# Altium schematic sheet GridSeed.SchDoc (part 1 of 2) (continued)
## Parts (continued)
C74  DB_VALUE: 470nF  [SMD_0603_CAPC1608X95N]
C75  DB_VALUE: 470nF  [SMD_0603_CAPC1608X95N]
C76  DB_VALUE: 470nF  [SMD_0603_CAPC1608X95N]
C77  DB_VALUE: 470nF  [SMD_0603_CAPC1608X95N]
C78  DB_VALUE: 470nF  [SMD_0603_CAPC1608X95N]
C79  DB_VALUE: 470nF  [SMD_0603_CAPC1608X95N]
C80  DB_VALUE: 470nF  [SMD_0603_CAPC1608X95N]
C81  DB_VALUE: 470nF  [SMD_0603_CAPC1608X95N]
C82  DB_VALUE: 470nF  [SMD_0603_CAPC1608X95N]
C83  DB_VALUE: 470nF  [SMD_0603_CAPC1608X95N]
C84  DB_VALUE: 470nF  [SMD_0603_CAPC1608X95N]
C85  DB_VALUE: 470nF  [SMD_0603_CAPC1608X95N]
C86  DB_VALUE: 2.2uF  DB_TOLERANCE: 5%  DB_VOLTAGE: 10V  [SMD_0805_CAPC2012X145N]
C87  DB_VALUE: 100pF  DB_TOLERANCE: 5%  DB_VOLTAGE: 50V  [SMD_0805_CAPC2012X145N]
C88  DB_VALUE: 47pF  DB_TOLERANCE: 5%  DB_VOLTAGE: 50V  [SMD_0805_CAPC2012X145N]
C89  DB_VALUE: 22pF  DB_TOLERANCE: 5%  DB_VOLTAGE: 50V  [SMD_0805_CAPC2012X145N]
C90  DB_VALUE: 2.2uF  DB_TOLERANCE: 5%  DB_VOLTAGE: 10V  [SMD_0805_CAPC2012X145N]
C91  DB_VALUE: 100pF  DB_TOLERANCE: 5%  DB_VOLTAGE: 50V  [SMD_0805_CAPC2012X145N]
C92  DB_VALUE: 47pF  DB_TOLERANCE: 5%  DB_VOLTAGE: 50V  [SMD_0805_CAPC2012X145N]
C93  DB_VALUE: 22pF  DB_TOLERANCE: 5%  DB_VOLTAGE: 50V  [SMD_0805_CAPC2012X145N]
C94  DB_VALUE: 2.2uF  DB_TOLERANCE: 5%  DB_VOLTAGE: 10V  [SMD_0805_CAPC2012X145N]
C95  DB_VALUE: 100pF  DB_TOLERANCE: 5%  DB_VOLTAGE: 50V  [SMD_0805_CAPC2012X145N]
C96  DB_VALUE: 47pF  DB_TOLERANCE: 5%  DB_VOLTAGE: 50V  [SMD_0805_CAPC2012X145N]
C97  DB_VALUE: 22pF  DB_TOLERANCE: 5%  DB_VOLTAGE: 50V  [SMD_0805_CAPC2012X145N]
C98  DB_VALUE: 2.2uF  DB_TOLERANCE: 5%  DB_VOLTAGE: 10V  [SMD_0805_CAPC2012X145N]
C99  DB_VALUE: 100pF  DB_TOLERANCE: 5%  DB_VOLTAGE: 50V  [SMD_0805_CAPC2012X145N]
C100  DB_VALUE: 47pF  DB_TOLERANCE: 5%  DB_VOLTAGE: 50V  [SMD_0805_CAPC2012X145N]
C101  DB_VALUE: 22pF  DB_TOLERANCE: 5%  DB_VOLTAGE: 50V  [SMD_0805_CAPC2012X145N]
C102  DB_VALUE: 2.2uF  DB_TOLERANCE: 5%  DB_VOLTAGE: 10V  [SMD_0805_CAPC2012X145N]
C103  DB_VALUE: 100pF  DB_TOLERANCE: 5%  DB_VOLTAGE: 50V  [SMD_0805_CAPC2012X145N]
C104  DB_VALUE: 47pF  DB_TOLERANCE: 5%  DB_VOLTAGE: 50V  [SMD_0805_CAPC2012X145N]
C105  DB_VALUE: 22pF  DB_TOLERANCE: 5%  DB_VOLTAGE: 50V  [SMD_0805_CAPC2012X145N]
C106  DB_VALUE: 2.2uF  DB_TOLERANCE: 5%  DB_VOLTAGE: 10V  [SMD_0805_CAPC2012X145N]
C107  DB_VALUE: 100pF  DB_TOLERANCE: 5%  DB_VOLTAGE: 50V  [SMD_0805_CAPC2012X145N]
C108  DB_VALUE: 47pF  DB_TOLERANCE: 5%  DB_VOLTAGE: 50V  [SMD_0805_CAPC2012X145N]
C109  DB_VALUE: 22pF  DB_TOLERANCE: 5%  DB_VOLTAGE: 50V  [SMD_0805_CAPC2012X145N]
C110  DB_VALUE: 2.2uF  DB_TOLERANCE: 5%  DB_VOLTAGE: 10V  [SMD_0805_CAPC2012X145N]
C111  DB_VALUE: 100pF  DB_TOLERANCE: 5%  DB_VOLTAGE: 50V  [SMD_0805_CAPC2012X145N]
C112  DB_VALUE: 47pF  DB_TOLERANCE: 5%  DB_VOLTAGE: 50V  [SMD_0805_CAPC2012X145N]
C113  DB_VALUE: 22pF  DB_TOLERANCE: 5%  DB_VOLTAGE: 50V  [SMD_0805_CAPC2012X145N]
C114  DB_VALUE: 2.2uF  DB_TOLERANCE: 5%  DB_VOLTAGE: 10V  [SMD_0805_CAPC2012X145N]
C115  DB_VALUE: 100pF  DB_TOLERANCE: 5%  DB_VOLTAGE: 50V  [SMD_0805_CAPC2012X145N]
C116  DB_VALUE: 47pF  DB_TOLERANCE: 5%  DB_VOLTAGE: 50V  [SMD_0805_CAPC2012X145N]
C117  DB_VALUE: 22pF  DB_TOLERANCE: 5%  DB_VOLTAGE: 50V  [SMD_0805_CAPC2012X145N]
C118  DB_VALUE: 470nF  [SMD_0603_CAPC1608X95N]
C119  DB_VALUE: 470nF  [SMD_0603_CAPC1608X95N]
C120  DB_VALUE: 470nF  [SMD_0603_CAPC1608X95N]
C121  DB_VALUE: 470nF  [SMD_0603_CAPC1608X95N]
C122  DB_VALUE: 470nF  [SMD_0603_CAPC1608X95N]
C123  DB_VALUE: 470nF  [SMD_0603_CAPC1608X95N]
C124  DB_VALUE: 470nF  [SMD_0603_CAPC1608X95N]
C125  DB_VALUE: 470nF  [SMD_0603_CAPC1608X95N]
C126  DB_VALUE: 470nF  [SMD_0603_CAPC1608X95N]
C127  DB_VALUE: 470nF  [SMD_0603_CAPC1608X95N]
C128  DB_VALUE: 470nF  [SMD_0603_CAPC1608X95N]
C129  DB_VALUE: 470nF  [SMD_0603_CAPC1608X95N]
C130  DB_VALUE: 470nF  [SMD_0603_CAPC1608X95N]
C131  DB_VALUE: 470nF  [SMD_0603_CAPC1608X95N]
C132  DB_VALUE: 470nF  [SMD_0603_CAPC1608X95N]
C133  DB_VALUE: 470nF  [SMD_0603_CAPC1608X95N]
C134  DB_VALUE: 470nF  [SMD_0603_CAPC1608X95N]
C135  DB_VALUE: 470nF  [SMD_0603_CAPC1608X95N]
C136  DB_VALUE: 470nF  [SMD_0603_CAPC1608X95N]
C137  DB_VALUE: 470nF  [SMD_0603_CAPC1608X95N]
C138  10uF/16V  DB_VALUE: 10uF  DB_TOLERANCE: 10%  DB_VOLTAGE: 16V  [SMD_0805_CAPC2012X145N]
C139  1nF  [SMD_0603_CAPC1608X95N]
C140  DB_VALUE: 470nF  [SMD_0603_CAPC1608X95N]
C141  DB_VALUE: 470nF  [SMD_0603_CAPC1608X95N]
C142  DB_VALUE: 470nF  [SMD_0603_CAPC1608X95N]
C143  DB_VALUE: 470nF  [SMD_0603_CAPC1608X95N]
C144  DB_VALUE: 470nF  [SMD_0603_CAPC1608X95N]
C145  DB_VALUE: 470nF  [SMD_0603_CAPC1608X95N]
C146  DB_VALUE: 470nF  [SMD_0603_CAPC1608X95N]
C147  DB_VALUE: 470nF  [SMD_0603_CAPC1608X95N]
C148  DB_VALUE: 470nF  [SMD_0603_CAPC1608X95N]
C149  DB_VALUE: 470nF  [SMD_0603_CAPC1608X95N]
C150  DB_VALUE: 470nF  [SMD_0603_CAPC1608X95N]
C151  DB_VALUE: 470nF  [SMD_0603_CAPC1608X95N]
C152  1nF  DB_TOLERANCE: 5%  DB_VOLTAGE: 25V  [SMD_0603_CAPC1608X95N]
C153  DB_VALUE: 470nF  [SMD_0603_CAPC1608X95N]
C154  DB_VALUE: 470nF  [SMD_0603_CAPC1608X95N]
C155  DB_VALUE: 470nF  [SMD_0603_CAPC1608X95N]
C156  DB_VALUE: 470nF  [SMD_0603_CAPC1608X95N]
C157  DB_VALUE: 470nF  [SMD_0603_CAPC1608X95N]
C158  DB_VALUE: 470nF  [SMD_0603_CAPC1608X95N]
C159  DB_VALUE: 470nF  [SMD_0603_CAPC1608X95N]
C160  DB_VALUE: 470nF  [SMD_0603_CAPC1608X95N]
C161  DB_VALUE: 470nF  [SMD_0603_CAPC1608X95N]
C162  DB_VALUE: 470nF  [SMD_0603_CAPC1608X95N]
C163  DB_VALUE: 470nF  [SMD_0603_CAPC1608X95N]
C164  DB_VALUE: 470nF  [SMD_0603_CAPC1608X95N]
C165  100nF  DB_TOLERANCE: 5%  DB_VOLTAGE: 50V  [SMD_0603_CAPC1608X95N]
C166  1nF  DB_TOLERANCE: 5%  DB_VOLTAGE: 25V  [SMD_0603_CAPC1608X95N]
C167  1nF  DB_TOLERANCE: 5%  DB_VOLTAGE: 25V  [SMD_0603_CAPC1608X95N]
C168  100nF  DB_TOLERANCE: 5%  DB_VOLTAGE: 50V  [SMD_0603_CAPC1608X95N]
C169  100nF  DB_TOLERANCE: 5%  DB_VOLTAGE: 50V  [SMD_0603_CAPC1608X95N]
C170  100nF  DB_TOLERANCE: 5%  DB_VOLTAGE: 50V  [SMD_0603_CAPC1608X95N]
C171  100nF  DB_TOLERANCE: 5%  DB_VOLTAGE: 50V  [SMD_0603_CAPC1608X95N]
C172  100nF  DB_TOLERANCE: 5%  DB_VOLTAGE: 50V  [SMD_0603_CAPC1608X95N]
C173  18pF  DB_TOLERANCE: 5%  DB_VOLTAGE: 50V  [SMD_0603_CAPC1608X95N]
C174  18pF  DB_TOLERANCE: 5%  DB_VOLTAGE: 50V  [SMD_0603_CAPC1608X95N]
C175  DB_VALUE: 470nF  [SMD_0603_CAPC1608X95N]
C176  DB_VALUE: 470nF  [SMD_0603_CAPC1608X95N]
C177  DB_VALUE: 470nF  [SMD_0603_CAPC1608X95N]
C178  DB_VALUE: 470nF  [SMD_0603_CAPC1608X95N]
C179  DB_VALUE: 470nF  [SMD_0603_CAPC1608X95N]
C180  DB_VALUE: 470nF  [SMD_0603_CAPC1608X95N]
C181  DB_VALUE: 470nF  [SMD_0603_CAPC1608X95N]
C182  DB_VALUE: 470nF  [SMD_0603_CAPC1608X95N]
C183  DB_VALUE: 470nF  [SMD_0603_CAPC1608X95N]
C184  DB_VALUE: 470nF  [SMD_0603_CAPC1608X95N]
C185  DB_VALUE: 470nF  [SMD_0603_CAPC1608X95N]
C186  DB_VALUE: 470nF  [SMD_0603_CAPC1608X95N]
C187  DB_VALUE: 470nF  [SMD_0603_CAPC1608X95N]
C188  DB_VALUE: 470nF  [SMD_0603_CAPC1608X95N]
C189  DB_VALUE: 470nF  [SMD_0603_CAPC1608X95N]
C190  DB_VALUE: 470nF  [SMD_0603_CAPC1608X95N]
C191  10uF/16V  DB_VALUE: 10uF  DB_TOLERANCE: 10%  DB_VOLTAGE: 16V  [SMD_0805_CAPC2012X145N]
C192  10uF/16V  DB_VALUE: 10uF  DB_TOLERANCE: 10%  DB_VOLTAGE: 16V  [SMD_0805_CAPC2012X145N]
C193  DB_VALUE: 22uF  DB_TOLERANCE: 10%  DB_VOLTAGE: 6.3V  [SMD_1210_CAPC3225X270N]
C194  22uF/6.3V  DB_VALUE: 22uF  DB_TOLERANCE: 20%  DB_VOLTAGE: 6.3V  [SMD_0805_CAPC2012X145N]
C195  DB_VALUE: 2.2uF  DB_TOLERANCE: 5%  DB_VOLTAGE: 10V  [SMD_0805_CAPC2012X145N]
C196  DB_VALUE: 100pF  DB_TOLERANCE: 5%  DB_VOLTAGE: 50V  [SMD_0805_CAPC2012X145N]
C197  47pF  DB_TOLERANCE: 5%  DB_VOLTAGE: 50V  [SMD_0805_CAPC2012X145N]
C198  DB_VALUE: 22pF  DB_TOLERANCE: 5%  DB_VOLTAGE: 50V  [SMD_0805_CAPC2012X145N]
C199  DB_VALUE: 2.2uF  DB_TOLERANCE: 5%  DB_VOLTAGE: 10V  [SMD_0805_CAPC2012X145N]
C200  DB_VALUE: 100pF  DB_TOLERANCE: 5%  DB_VOLTAGE: 50V  [SMD_0805_CAPC2012X145N]
C201  DB_VALUE: 47pF  DB_TOLERANCE: 5%  DB_VOLTAGE: 50V  [SMD_0805_CAPC2012X145N]
C202  DB_VALUE: 22pF  DB_TOLERANCE: 5%  DB_VOLTAGE: 50V  [SMD_0805_CAPC2012X145N]
C203  DB_VALUE: 2.2uF  DB_TOLERANCE: 5%  DB_VOLTAGE: 10V  [SMD_0805_CAPC2012X145N]
C204  DB_VALUE: 100pF  DB_TOLERANCE: 5%  DB_VOLTAGE: 50V  [SMD_0805_CAPC2012X145N]
C205  DB_VALUE: 47pF  DB_TOLERANCE: 5%  DB_VOLTAGE: 50V  [SMD_0805_CAPC2012X145N]
C206  DB_VALUE: 22pF  DB_TOLERANCE: 5%  DB_VOLTAGE: 50V  [SMD_0805_CAPC2012X145N]
C207  DB_VALUE: 2.2uF  DB_TOLERANCE: 5%  DB_VOLTAGE: 10V  [SMD_0805_CAPC2012X145N]
C208  DB_VALUE: 100pF  DB_TOLERANCE: 5%  DB_VOLTAGE: 50V  [SMD_0805_CAPC2012X145N]
C209  DB_VALUE: 47pF  DB_TOLERANCE: 5%  DB_VOLTAGE: 50V  [SMD_0805_CAPC2012X145N]
C210  DB_VALUE: 22pF  DB_TOLERANCE: 5%  DB_VOLTAGE: 50V  [SMD_0805_CAPC2012X145N]
C211  DB_VALUE: 2.2uF  DB_TOLERANCE: 5%  DB_VOLTAGE: 10V  [SMD_0805_CAPC2012X145N]
C212  DB_VALUE: 100pF  DB_TOLERANCE: 5%  DB_VOLTAGE: 50V  [SMD_0805_CAPC2012X145N]
C213  DB_VALUE: 47pF  DB_TOLERANCE: 5%  DB_VOLTAGE: 50V  [SMD_0805_CAPC2012X145N]
C214  DB_VALUE: 22pF  DB_TOLERANCE: 5%  DB_VOLTAGE: 50V  [SMD_0805_CAPC2012X145N]
C215  DB_VALUE: 2.2uF  DB_TOLERANCE: 5%  DB_VOLTAGE: 10V  [SMD_0805_CAPC2012X145N]
C216  DB_VALUE: 100pF  DB_TOLERANCE: 5%  DB_VOLTAGE: 50V  [SMD_0805_CAPC2012X145N]
C217  DB_VALUE: 47pF  DB_TOLERANCE: 5%  DB_VOLTAGE: 50V  [SMD_0805_CAPC2012X145N]
C218  DB_VALUE: 22pF  DB_TOLERANCE: 5%  DB_VOLTAGE: 50V  [SMD_0805_CAPC2012X145N]
C219  DB_VALUE: 2.2uF  DB_TOLERANCE: 5%  DB_VOLTAGE: 10V  [SMD_0805_CAPC2012X145N]
C220  DB_VALUE: 100pF  DB_TOLERANCE: 5%  DB_VOLTAGE: 50V  [SMD_0805_CAPC2012X145N]
C221  DB_VALUE: 47pF  DB_TOLERANCE: 5%  DB_VOLTAGE: 50V  [SMD_0805_CAPC2012X145N]
C222  DB_VALUE: 22pF  DB_TOLERANCE: 5%  DB_VOLTAGE: 50V  [SMD_0805_CAPC2012X145N]
C223  DB_VALUE: 2.2uF  DB_TOLERANCE: 5%  DB_VOLTAGE: 10V  [SMD_0805_CAPC2012X145N]
C224  DB_VALUE: 100pF  DB_TOLERANCE: 5%  DB_VOLTAGE: 50V  [SMD_0805_CAPC2012X145N]
C225  DB_VALUE: 47pF  DB_TOLERANCE: 5%  DB_VOLTAGE: 50V  [SMD_0805_CAPC2012X145N]
C226  DB_VALUE: 22pF  DB_TOLERANCE: 5%  DB_VOLTAGE: 50V  [SMD_0805_CAPC2012X145N]
C227  DB_VALUE: 470nF  [SMD_0603_CAPC1608X95N]
C228  DB_VALUE: 470nF  [SMD_0603_CAPC1608X95N]
C229  DB_VALUE: 470nF  [SMD_0603_CAPC1608X95N]
C230  DB_VALUE: 470nF  [SMD_0603_CAPC1608X95N]
C231  DB_VALUE: 470nF  [SMD_0603_CAPC1608X95N]
C232  DB_VALUE: 470nF  [SMD_0603_CAPC1608X95N]
C233  DB_VALUE: 470nF  [SMD_0603_CAPC1608X95N]
C234  DB_VALUE: 470nF  [SMD_0603_CAPC1608X95N]
C235  DB_VALUE: 470nF  [SMD_0603_CAPC1608X95N]
C236  DB_VALUE: 470nF  [SMD_0603_CAPC1608X95N]
C237  DB_VALUE: 470nF  [SMD_0603_CAPC1608X95N]
C238  DB_VALUE: 470nF  [SMD_0603_CAPC1608X95N]
C239  DB_VALUE: 470nF  [SMD_0603_CAPC1608X95N]
C240  DB_VALUE: 470nF  [SMD_0603_CAPC1608X95N]
C241  DB_VALUE: 470nF  [SMD_0603_CAPC1608X95N]
C242  DB_VALUE: 470nF  [SMD_0603_CAPC1608X95N]
C243  DB_VALUE: 470nF  [SMD_0603_CAPC1608X95N]
C244  DB_VALUE: 470nF  [SMD_0603_CAPC1608X95N]
C245  DB_VALUE: 470nF  [SMD_0603_CAPC1608X95N]
C246  DB_VALUE: 470nF  [SMD_0603_CAPC1608X95N]
C248  22uF/6.3V  DB_VALUE: 22uF  DB_TOLERANCE: 20%  DB_VOLTAGE: 6.3V  [SMD_0805_CAPC2012X145N]
C249  100nF  DB_TOLERANCE: 5%  DB_VOLTAGE: 50V  [SMD_0603_CAPC1608X95N]
C250  100nF  DB_TOLERANCE: 5%  DB_VOLTAGE: 50V  [SMD_0603_CAPC1608X95N]
C251  DB_VALUE: 470nF  [SMD_0603_CAPC1608X95N]
C252  DB_VALUE: 470nF  [SMD_0603_CAPC1608X95N]
C253  DB_VALUE: 470nF  [SMD_0603_CAPC1608X95N]
C254  DB_VALUE: 470nF  [SMD_0603_CAPC1608X95N]
C255  DB_VALUE: 470nF  [SMD_0603_CAPC1608X95N]
C256  DB_VALUE: 470nF  [SMD_0603_CAPC1608X95N]
C257  DB_VALUE: 470nF  [SMD_0603_CAPC1608X95N]
C258  DB_VALUE: 470nF  [SMD_0603_CAPC1608X95N]
C259  DB_VALUE: 470nF  [SMD_0603_CAPC1608X95N]
C260  DB_VALUE: 470nF  [SMD_0603_CAPC1608X95N]
C261  DB_VALUE: 470nF  [SMD_0603_CAPC1608X95N]
C262  DB_VALUE: 470nF  [SMD_0603_CAPC1608X95N]
C263  DB_VALUE: 470nF  [SMD_0603_CAPC1608X95N]
C264  DB_VALUE: 470nF  [SMD_0603_CAPC1608X95N]
C265  DB_VALUE: 470nF  [SMD_0603_CAPC1608X95N]
C266  DB_VALUE: 470nF  [SMD_0603_CAPC1608X95N]
C267  22uF/6.3V  DB_VALUE: 22uF  DB_TOLERANCE: 20%  DB_VOLTAGE: 6.3V  [SMD_0805_CAPC2012X145N]
C268  DB_VALUE: 470nF  [SMD_0603_CAPC1608X95N]
C269  DB_VALUE: 470nF  [SMD_0603_CAPC1608X95N]
C270  DB_VALUE: 470nF  [SMD_0603_CAPC1608X95N]
C271  DB_VALUE: 470nF  [SMD_0603_CAPC1608X95N]
C272  DB_VALUE: 470nF  [SMD_0603_CAPC1608X95N]
C273  DB_VALUE: 470nF  [SMD_0603_CAPC1608X95N]
C274  DB_VALUE: 470nF  [SMD_0603_CAPC1608X95N]
C275  DB_VALUE: 470nF  [SMD_0603_CAPC1608X95N]
C276  10uF/16V  DB_VALUE: 10uF  DB_TOLERANCE: 10%  DB_VOLTAGE: 16V  [SMD_0805_CAPC2012X145N]
C277  DB_VALUE: 470nF  [SMD_0603_CAPC1608X95N]
C278  DB_VALUE: 470nF  [SMD_0603_CAPC1608X95N]
C279  DB_VALUE: 470nF  [SMD_0603_CAPC1608X95N]
C280  DB_VALUE: 470nF  [SMD_0603_CAPC1608X95N]
C281  DB_VALUE: 470nF  [SMD_0603_CAPC1608X95N]
C282  DB_VALUE: 470nF  [SMD_0603_CAPC1608X95N]
C283  DB_VALUE: 470nF  [SMD_0603_CAPC1608X95N]
C284  DB_VALUE: 470nF  [SMD_0603_CAPC1608X95N]
C285  DB_VALUE: 470nF  [SMD_0603_CAPC1608X95N]
C286  DB_VALUE: 470nF  [SMD_0603_CAPC1608X95N]
C287  DB_VALUE: 470nF  [SMD_0603_CAPC1608X95N]
C288  DB_VALUE: 470nF  [SMD_0603_CAPC1608X95N]
C289  DB_VALUE: 470nF  [SMD_0603_CAPC1608X95N]
C290  DB_VALUE: 470nF  [SMD_0603_CAPC1608X95N]
C291  DB_VALUE: 470nF  [SMD_0603_CAPC1608X95N]
C292  DB_VALUE: 470nF  [SMD_0603_CAPC1608X95N]
C293  DB_VALUE: 2.2uF  DB_TOLERANCE: 5%  DB_VOLTAGE: 10V  [SMD_0805_CAPC2012X145N]
C294  DB_VALUE: 100pF  DB_TOLERANCE: 5%  DB_VOLTAGE: 50V  [SMD_0805_CAPC2012X145N]
C295  DB_VALUE: 47pF  DB_TOLERANCE: 5%  DB_VOLTAGE: 50V  [SMD_0805_CAPC2012X145N]
C296  DB_VALUE: 22pF  DB_TOLERANCE: 5%  DB_VOLTAGE: 50V  [SMD_0805_CAPC2012X145N]
C297  DB_VALUE: 2.2uF  DB_TOLERANCE: 5%  DB_VOLTAGE: 10V  [SMD_0805_CAPC2012X145N]
C298  DB_VALUE: 100pF  DB_TOLERANCE: 5%  DB_VOLTAGE: 50V  [SMD_0805_CAPC2012X145N]
C299  DB_VALUE: 47pF  DB_TOLERANCE: 5%  DB_VOLTAGE: 50V  [SMD_0805_CAPC2012X145N]
C300  DB_VALUE: 22pF  DB_TOLERANCE: 5%  DB_VOLTAGE: 50V  [SMD_0805_CAPC2012X145N]
C301  DB_VALUE: 2.2uF  DB_TOLERANCE: 5%  DB_VOLTAGE: 10V  [SMD_0805_CAPC2012X145N]
C302  DB_VALUE: 100pF  DB_TOLERANCE: 5%  DB_VOLTAGE: 50V  [SMD_0805_CAPC2012X145N]
C303  DB_VALUE: 47pF  DB_TOLERANCE: 5%  DB_VOLTAGE: 50V  [SMD_0805_CAPC2012X145N]
C304  DB_VALUE: 22pF  DB_TOLERANCE: 5%  DB_VOLTAGE: 50V  [SMD_0805_CAPC2012X145N]
C305  DB_VALUE: 2.2uF  DB_TOLERANCE: 5%  DB_VOLTAGE: 10V  [SMD_0805_CAPC2012X145N]
C306  DB_VALUE: 100pF  DB_TOLERANCE: 5%  DB_VOLTAGE: 50V  [SMD_0805_CAPC2012X145N]
C307  DB_VALUE: 47pF  DB_TOLERANCE: 5%  DB_VOLTAGE: 50V  [SMD_0805_CAPC2012X145N]
C308  DB_VALUE: 22pF  DB_TOLERANCE: 5%  DB_VOLTAGE: 50V  [SMD_0805_CAPC2012X145N]
C309  DB_VALUE: 2.2uF  DB_TOLERANCE: 5%  DB_VOLTAGE: 10V  [SMD_0805_CAPC2012X145N]
C310  DB_VALUE: 100pF  DB_TOLERANCE: 5%  DB_VOLTAGE: 50V  [SMD_0805_CAPC2012X145N]
C311  DB_VALUE: 47pF  DB_TOLERANCE: 5%  DB_VOLTAGE: 50V  [SMD_0805_CAPC2012X145N]
C312  DB_VALUE: 22pF  DB_TOLERANCE: 5%  DB_VOLTAGE: 50V  [SMD_0805_CAPC2012X145N]
C313  DB_VALUE: 2.2uF  DB_TOLERANCE: 5%  DB_VOLTAGE: 10V  [SMD_0805_CAPC2012X145N]
C314  DB_VALUE: 100pF  DB_TOLERANCE: 5%  DB_VOLTAGE: 50V  [SMD_0805_CAPC2012X145N]
C315  DB_VALUE: 47pF  DB_TOLERANCE: 5%  DB_VOLTAGE: 50V  [SMD_0805_CAPC2012X145N]
C316  DB_VALUE: 22pF  DB_TOLERANCE: 5%  DB_VOLTAGE: 50V  [SMD_0805_CAPC2012X145N]
C317  DB_VALUE: 2.2uF  DB_TOLERANCE: 5%  DB_VOLTAGE: 10V  [SMD_0805_CAPC2012X145N]
C318  DB_VALUE: 100pF  DB_TOLERANCE: 5%  DB_VOLTAGE: 50V  [SMD_0805_CAPC2012X145N]
C319  DB_VALUE: 47pF  DB_TOLERANCE: 5%  DB_VOLTAGE: 50V  [SMD_0805_CAPC2012X145N]
C320  DB_VALUE: 22pF  DB_TOLERANCE: 5%  DB_VOLTAGE: 50V  [SMD_0805_CAPC2012X145N]
C321  DB_VALUE: 2.2uF  DB_TOLERANCE: 5%  DB_VOLTAGE: 10V  [SMD_0805_CAPC2012X145N]
C322  DB_VALUE: 100pF  DB_TOLERANCE: 5%  DB_VOLTAGE: 50V  [SMD_0805_CAPC2012X145N]
C323  DB_VALUE: 47pF  DB_TOLERANCE: 5%  DB_VOLTAGE: 50V  [SMD_0805_CAPC2012X145N]
C324  DB_VALUE: 22pF  DB_TOLERANCE: 5%  DB_VOLTAGE: 50V  [SMD_0805_CAPC2012X145N]
C325  DB_VALUE: 470nF  [SMD_0603_CAPC1608X95N]
C326  DB_VALUE: 470nF  [SMD_0603_CAPC1608X95N]
C327  DB_VALUE: 470nF  [SMD_0603_CAPC1608X95N]
C328  DB_VALUE: 470nF  [SMD_0603_CAPC1608X95N]
C329  DB_VALUE: 470nF  [SMD_0603_CAPC1608X95N]
C330  DB_VALUE: 470nF  [SMD_0603_CAPC1608X95N]
C331  DB_VALUE: 470nF  [SMD_0603_CAPC1608X95N]
C332  DB_VALUE: 470nF  [SMD_0603_CAPC1608X95N]
C333  DB_VALUE: 470nF  [SMD_0603_CAPC1608X95N]
C334  DB_VALUE: 470nF  [SMD_0603_CAPC1608X95N]
C335  DB_VALUE: 470nF  [SMD_0603_CAPC1608X95N]
C336  DB_VALUE: 470nF  [SMD_0603_CAPC1608X95N]
C337  DB_VALUE: 470nF  [SMD_0603_CAPC1608X95N]
C338  DB_VALUE: 470nF  [SMD_0603_CAPC1608X95N]
C339  DB_VALUE: 470nF  [SMD_0603_CAPC1608X95N]
C340  DB_VALUE: 470nF  [SMD_0603_CAPC1608X95N]
C341  DB_VALUE: 470nF  [SMD_0603_CAPC1608X95N]
C342  DB_VALUE: 470nF  [SMD_0603_CAPC1608X95N]
C343  DB_VALUE: 470nF  [SMD_0603_CAPC1608X95N]
C344  DB_VALUE: 470nF  [SMD_0603_CAPC1608X95N]
C345  DB_VALUE: 470nF  [SMD_0603_CAPC1608X95N]
C346  DB_VALUE: 470nF  [SMD_0603_CAPC1608X95N]
C347  DB_VALUE: 470nF  [SMD_0603_CAPC1608X95N]
C348  DB_VALUE: 470nF  [SMD_0603_CAPC1608X95N]
C349  DB_VALUE: 470nF  [SMD_0603_CAPC1608X95N]
C350  DB_VALUE: 470nF  [SMD_0603_CAPC1608X95N]
C351  DB_VALUE: 470nF  [SMD_0603_CAPC1608X95N]
C352  DB_VALUE: 470nF  [SMD_0603_CAPC1608X95N]
C353  DB_VALUE: 470nF  [SMD_0603_CAPC1608X95N]
C354  DB_VALUE: 470nF  [SMD_0603_CAPC1608X95N]
C355  DB_VALUE: 470nF  [SMD_0603_CAPC1608X95N]
C356  DB_VALUE: 470nF  [SMD_0603_CAPC1608X95N]
C357  DB_VALUE: 470nF  [SMD_0603_CAPC1608X95N]
C358  DB_VALUE: 470nF  [SMD_0603_CAPC1608X95N]
C359  DB_VALUE: 470nF  [SMD_0603_CAPC1608X95N]
C360  DB_VALUE: 470nF  [SMD_0603_CAPC1608X95N]
C361  DB_VALUE: 470nF  [SMD_0603_CAPC1608X95N]
C362  DB_VALUE: 470nF  [SMD_0603_CAPC1608X95N]
C363  DB_VALUE: 470nF  [SMD_0603_CAPC1608X95N]
C364  DB_VALUE: 470nF  [SMD_0603_CAPC1608X95N]
C365  DB_VALUE: 470nF  [SMD_0603_CAPC1608X95N]
C366  DB_VALUE: 470nF  [SMD_0603_CAPC1608X95N]
C367  DB_VALUE: 470nF  [SMD_0603_CAPC1608X95N]
C368  DB_VALUE: 470nF  [SMD_0603_CAPC1608X95N]
C369  DB_VALUE: 470nF  [SMD_0603_CAPC1608X95N]
C370  DB_VALUE: 470nF  [SMD_0603_CAPC1608X95N]
C371  DB_VALUE: 470nF  [SMD_0603_CAPC1608X95N]
C372  DB_VALUE: 470nF  [SMD_0603_CAPC1608X95N]
C373  DB_VALUE: 470nF  [SMD_0603_CAPC1608X95N]
C374  DB_VALUE: 470nF  [SMD_0603_CAPC1608X95N]
C375  DB_VALUE: 470nF  [SMD_0603_CAPC1608X95N]
C376  DB_VALUE: 470nF  [SMD_0603_CAPC1608X95N]
C377  DB_VALUE: 470nF  [SMD_0603_CAPC1608X95N]
C378  DB_VALUE: 470nF  [SMD_0603_CAPC1608X95N]
C379  DB_VALUE: 470nF  [SMD_0603_CAPC1608X95N]
C380  DB_VALUE: 470nF  [SMD_0603_CAPC1608X95N]
C381  DB_VALUE: 470nF  [SMD_0603_CAPC1608X95N]
C382  DB_VALUE: 470nF  [SMD_0603_CAPC1608X95N]
C383  DB_VALUE: 470nF  [SMD_0603_CAPC1608X95N]
C384  DB_VALUE: 470nF  [SMD_0603_CAPC1608X95N]
C385  DB_VALUE: 2.2uF  DB_TOLERANCE: 5%  DB_VOLTAGE: 10V  [SMD_0805_CAPC2012X145N]
C386  DB_VALUE: 100pF  DB_TOLERANCE: 5%  DB_VOLTAGE: 50V  [SMD_0805_CAPC2012X145N]
C387  DB_VALUE: 47pF  DB_TOLERANCE: 5%  DB_VOLTAGE: 50V  [SMD_0805_CAPC2012X145N]
C388  DB_VALUE: 22pF  DB_TOLERANCE: 5%  DB_VOLTAGE: 50V  [SMD_0805_CAPC2012X145N]
C389  DB_VALUE: 2.2uF  DB_TOLERANCE: 5%  DB_VOLTAGE: 10V  [SMD_0805_CAPC2012X145N]
C390  DB_VALUE: 100pF  DB_TOLERANCE: 5%  DB_VOLTAGE: 50V  [SMD_0805_CAPC2012X145N]
C391  DB_VALUE: 47pF  DB_TOLERANCE: 5%  DB_VOLTAGE: 50V  [SMD_0805_CAPC2012X145N]
C392  DB_VALUE: 22pF  DB_TOLERANCE: 5%  DB_VOLTAGE: 50V  [SMD_0805_CAPC2012X145N]
C393  DB_VALUE: 2.2uF  DB_TOLERANCE: 5%  DB_VOLTAGE: 10V  [SMD_0805_CAPC2012X145N]
C394  DB_VALUE: 100pF  DB_TOLERANCE: 5%  DB_VOLTAGE: 50V  [SMD_0805_CAPC2012X145N]
C395  DB_VALUE: 47pF  DB_TOLERANCE: 5%  DB_VOLTAGE: 50V  [SMD_0805_CAPC2012X145N]
C396  DB_VALUE: 22pF  DB_TOLERANCE: 5%  DB_VOLTAGE: 50V  [SMD_0805_CAPC2012X145N]
C397  DB_VALUE: 2.2uF  DB_TOLERANCE: 5%  DB_VOLTAGE: 10V  [SMD_0805_CAPC2012X145N]
C398  DB_VALUE: 100pF  DB_TOLERANCE: 5%  DB_VOLTAGE: 50V  [SMD_0805_CAPC2012X145N]
C399  DB_VALUE: 47pF  DB_TOLERANCE: 5%  DB_VOLTAGE: 50V  [SMD_0805_CAPC2012X145N]
C400  DB_VALUE: 22pF  DB_TOLERANCE: 5%  DB_VOLTAGE: 50V  [SMD_0805_CAPC2012X145N]
C401  DB_VALUE: 2.2uF  DB_TOLERANCE: 5%  DB_VOLTAGE: 10V  [SMD_0805_CAPC2012X145N]
C402  DB_VALUE: 100pF  DB_TOLERANCE: 5%  DB_VOLTAGE: 50V  [SMD_0805_CAPC2012X145N]
C403  DB_VALUE: 47pF  DB_TOLERANCE: 5%  DB_VOLTAGE: 50V  [SMD_0805_CAPC2012X145N]
C404  DB_VALUE: 22pF  DB_TOLERANCE: 5%  DB_VOLTAGE: 50V  [SMD_0805_CAPC2012X145N]
C405  DB_VALUE: 2.2uF  DB_TOLERANCE: 5%  DB_VOLTAGE: 10V  [SMD_0805_CAPC2012X145N]
C406  DB_VALUE: 100pF  DB_TOLERANCE: 5%  DB_VOLTAGE: 50V  [SMD_0805_CAPC2012X145N]
C407  DB_VALUE: 47pF  DB_TOLERANCE: 5%  DB_VOLTAGE: 50V  [SMD_0805_CAPC2012X145N]
C408  DB_VALUE: 22pF  DB_TOLERANCE: 5%  DB_VOLTAGE: 50V  [SMD_0805_CAPC2012X145N]
C409  DB_VALUE: 2.2uF  DB_TOLERANCE: 5%  DB_VOLTAGE: 10V  [SMD_0805_CAPC2012X145N]
C410  DB_VALUE: 100pF  DB_TOLERANCE: 5%  DB_VOLTAGE: 50V  [SMD_0805_CAPC2012X145N]
C411  DB_VALUE: 47pF  DB_TOLERANCE: 5%  DB_VOLTAGE: 50V  [SMD_0805_CAPC2012X145N]
C412  DB_VALUE: 22pF  DB_TOLERANCE: 5%  DB_VOLTAGE: 50V  [SMD_0805_CAPC2012X145N]
C413  DB_VALUE: 2.2uF  DB_TOLERANCE: 5%  DB_VOLTAGE: 10V  [SMD_0805_CAPC2012X145N]
C414  DB_VALUE: 100pF  DB_TOLERANCE: 5%  DB_VOLTAGE: 50V  [SMD_0805_CAPC2012X145N]
C415  DB_VALUE: 47pF  DB_TOLERANCE: 5%  DB_VOLTAGE: 50V  [SMD_0805_CAPC2012X145N]
C416  DB_VALUE: 22pF  DB_TOLERANCE: 5%  DB_VOLTAGE: 50V  [SMD_0805_CAPC2012X145N]
C_1  DB_VALUE: 22uF  DB_TOLERANCE: 10%  DB_VOLTAGE: 6.3V  [SMD_1210_CAPC3225X270N]
C_2  DB_VALUE: 22uF  DB_TOLERANCE: 10%  DB_VOLTAGE: 6.3V  [SMD_1210_CAPC3225X270N]
C_3  DB_VALUE: 22uF  DB_TOLERANCE: 10%  DB_VOLTAGE: 6.3V  [SMD_1210_CAPC3225X270N]
C_4  DB_VALUE: 22uF  DB_TOLERANCE: 10%  DB_VOLTAGE: 6.3V  [SMD_1210_CAPC3225X270N]
C_5  DB_VALUE: 22uF  DB_TOLERANCE: 10%  DB_VOLTAGE: 6.3V  [SMD_1210_CAPC3225X270N]
C_6  DB_VALUE: 22uF  DB_TOLERANCE: 10%  DB_VOLTAGE: 6.3V  [SMD_1210_CAPC3225X270N]
C_7  DB_VALUE: 22uF  DB_TOLERANCE: 10%  DB_VOLTAGE: 6.3V  [SMD_1210_CAPC3225X270N]
C_8  DB_VALUE: 22uF  DB_TOLERANCE: 10%  DB_VOLTAGE: 6.3V  [SMD_1210_CAPC3225X270N]
C_9  DB_VALUE: 22uF  DB_TOLERANCE: 10%  DB_VOLTAGE: 6.3V  [SMD_1210_CAPC3225X270N]
C_10  DB_VALUE: 22uF  DB_TOLERANCE: 10%  DB_VOLTAGE: 6.3V  [SMD_1210_CAPC3225X270N]
C_11  DB_VALUE: 22uF  DB_TOLERANCE: 10%  DB_VOLTAGE: 6.3V  [SMD_1210_CAPC3225X270N]
C_12  DB_VALUE: 22uF  DB_TOLERANCE: 10%  DB_VOLTAGE: 6.3V  [SMD_1210_CAPC3225X270N]
C_13  DB_VALUE: 22uF  DB_TOLERANCE: 10%  DB_VOLTAGE: 6.3V  [SMD_1210_CAPC3225X270N]
C_14  DB_VALUE: 22uF  DB_TOLERANCE: 10%  DB_VOLTAGE: 6.3V  [SMD_1210_CAPC3225X270N]
C_15  DB_VALUE: 22uF  DB_TOLERANCE: 10%  DB_VOLTAGE: 6.3V  [SMD_1210_CAPC3225X270N]
C_16  DB_VALUE: 22uF  DB_TOLERANCE: 10%  DB_VOLTAGE: 6.3V  [SMD_1210_CAPC3225X270N]
C_17  DB_VALUE: 22uF  DB_TOLERANCE: 10%  DB_VOLTAGE: 6.3V  [SMD_1210_CAPC3225X270N]
C_18  DB_VALUE: 22uF  DB_TOLERANCE: 10%  DB_VOLTAGE: 6.3V  [SMD_1210_CAPC3225X270N]
C_19  DB_VALUE: 22uF  DB_TOLERANCE: 10%  DB_VOLTAGE: 6.3V  [SMD_1210_CAPC3225X270N]
C_20  DB_VALUE: 22uF  DB_TOLERANCE: 10%  DB_VOLTAGE: 6.3V  [SMD_1210_CAPC3225X270N]
C_21  DB_VALUE: 22uF  DB_TOLERANCE: 10%  DB_VOLTAGE: 6.3V  [SMD_1210_CAPC3225X270N]
C_22  DB_VALUE: 22uF  DB_TOLERANCE: 10%  DB_VOLTAGE: 6.3V  [SMD_1210_CAPC3225X270N]
C_23  DB_VALUE: 22uF  DB_TOLERANCE: 10%  DB_VOLTAGE: 6.3V  [SMD_1210_CAPC3225X270N]
C_24  DB_VALUE: 22uF  DB_TOLERANCE: 10%  DB_VOLTAGE: 6.3V  [SMD_1210_CAPC3225X270N]
C_25  DB_VALUE: 22uF  DB_TOLERANCE: 10%  DB_VOLTAGE: 6.3V  [SMD_1210_CAPC3225X270N]
C_26  DB_VALUE: 22uF  DB_TOLERANCE: 10%  DB_VOLTAGE: 6.3V  [SMD_1210_CAPC3225X270N]
C_27  DB_VALUE: 22uF  DB_TOLERANCE: 10%  DB_VOLTAGE: 6.3V  [SMD_1210_CAPC3225X270N]
C_28  DB_VALUE: 22uF  DB_TOLERANCE: 10%  DB_VOLTAGE: 6.3V  [SMD_1210_CAPC3225X270N]
C_29  DB_VALUE: 22uF  DB_TOLERANCE: 10%  DB_VOLTAGE: 6.3V  [SMD_1210_CAPC3225X270N]
C_30  DB_VALUE: 22uF  DB_TOLERANCE: 10%  DB_VOLTAGE: 6.3V  [SMD_1210_CAPC3225X270N]
C_31  DB_VALUE: 22uF  DB_TOLERANCE: 10%  DB_VOLTAGE: 6.3V  [SMD_1210_CAPC3225X270N]
C_32  DB_VALUE: 22uF  DB_TOLERANCE: 10%  DB_VOLTAGE: 6.3V  [SMD_1210_CAPC3225X270N]
C_33  DB_VALUE: 22uF  DB_TOLERANCE: 10%  DB_VOLTAGE: 6.3V  [SMD_1210_CAPC3225X270N]
C_34  DB_VALUE: 22uF  DB_TOLERANCE: 10%  DB_VOLTAGE: 6.3V  [SMD_1210_CAPC3225X270N]
C_35  DB_VALUE: 22uF  DB_TOLERANCE: 10%  DB_VOLTAGE: 6.3V  [SMD_1210_CAPC3225X270N]
C_36  DB_VALUE: 22uF  DB_TOLERANCE: 10%  DB_VOLTAGE: 6.3V  [SMD_1210_CAPC3225X270N]
C_37  DB_VALUE: 22uF  DB_TOLERANCE: 10%  DB_VOLTAGE: 6.3V  [SMD_1210_CAPC3225X270N]
C_38  DB_VALUE: 22uF  DB_TOLERANCE: 10%  DB_VOLTAGE: 6.3V  [SMD_1210_CAPC3225X270N]
C_39  DB_VALUE: 22uF  DB_TOLERANCE: 10%  DB_VOLTAGE: 6.3V  [SMD_1210_CAPC3225X270N]
C_40  DB_VALUE: 22uF  DB_TOLERANCE: 10%  DB_VOLTAGE: 6.3V  [SMD_1210_CAPC3225X270N]
C_41  DB_VALUE: 22uF  DB_TOLERANCE: 10%  DB_VOLTAGE: 6.3V  [SMD_1210_CAPC3225X270N]
C_42  DB_VALUE: 22uF  DB_TOLERANCE: 10%  DB_VOLTAGE: 6.3V  [SMD_1210_CAPC3225X270N]
C_43  DB_VALUE: 22uF  DB_TOLERANCE: 10%  DB_VOLTAGE: 6.3V  [SMD_1210_CAPC3225X270N]
C_44  DB_VALUE: 22uF  DB_TOLERANCE: 10%  DB_VOLTAGE: 6.3V  [SMD_1210_CAPC3225X270N]
C_45  DB_VALUE: 22uF  DB_TOLERANCE: 10%  DB_VOLTAGE: 6.3V  [SMD_1210_CAPC3225X270N]
C_46  DB_VALUE: 22uF  DB_TOLERANCE: 10%  DB_VOLTAGE: 6.3V  [SMD_1210_CAPC3225X270N]
C_47  DB_VALUE: 22uF  DB_TOLERANCE: 10%  DB_VOLTAGE: 6.3V  [SMD_1210_CAPC3225X270N]
C_48  DB_VALUE: 22uF  DB_TOLERANCE: 10%  DB_VOLTAGE: 6.3V  [SMD_1210_CAPC3225X270N]
C_49  DB_VALUE: 22uF  DB_TOLERANCE: 10%  DB_VOLTAGE: 6.3V  [SMD_1210_CAPC3225X270N]
C_50  DB_VALUE: 22uF  DB_TOLERANCE: 10%  DB_VOLTAGE: 6.3V  [SMD_1210_CAPC3225X270N]
C_51  DB_VALUE: 22uF  DB_TOLERANCE: 10%  DB_VOLTAGE: 6.3V  [SMD_1210_CAPC3225X270N]
C_52  DB_VALUE: 22uF  DB_TOLERANCE: 10%  DB_VOLTAGE: 6.3V  [SMD_1210_CAPC3225X270N]
C_53  DB_VALUE: 22uF  DB_TOLERANCE: 10%  DB_VOLTAGE: 6.3V  [SMD_1210_CAPC3225X270N]
C_54  DB_VALUE: 22uF  DB_TOLERANCE: 10%  DB_VOLTAGE: 6.3V  [SMD_1210_CAPC3225X270N]
C_55  DB_VALUE: 22uF  DB_TOLERANCE: 10%  DB_VOLTAGE: 6.3V  [SMD_1210_CAPC3225X270N]
C_56  DB_VALUE: 22uF  DB_TOLERANCE: 10%  DB_VOLTAGE: 6.3V  [SMD_1210_CAPC3225X270N]
C_57  DB_VALUE: 22uF  DB_TOLERANCE: 10%  DB_VOLTAGE: 6.3V  [SMD_1210_CAPC3225X270N]
C_58  DB_VALUE: 22uF  DB_TOLERANCE: 10%  DB_VOLTAGE: 6.3V  [SMD_1210_CAPC3225X270N]
C_59  DB_VALUE: 22uF  DB_TOLERANCE: 10%  DB_VOLTAGE: 6.3V  [SMD_1210_CAPC3225X270N]
C_60  DB_VALUE: 22uF  DB_TOLERANCE: 10%  DB_VOLTAGE: 6.3V  [SMD_1210_CAPC3225X270N]
C_61  DB_VALUE: 22uF  DB_TOLERANCE: 10%  DB_VOLTAGE: 6.3V  [SMD_1210_CAPC3225X270N]
C_62  DB_VALUE: 22uF  DB_TOLERANCE: 10%  DB_VOLTAGE: 6.3V  [SMD_1210_CAPC3225X270N]
C_63  DB_VALUE: 22uF  DB_TOLERANCE: 10%  DB_VOLTAGE: 6.3V  [SMD_1210_CAPC3225X270N]
C_64  DB_VALUE: 22uF  DB_TOLERANCE: 10%  DB_VOLTAGE: 6.3V  [SMD_1210_CAPC3225X270N]
C_65  DB_VALUE: 22uF  DB_TOLERANCE: 10%  DB_VOLTAGE: 6.3V  [SMD_1210_CAPC3225X270N]
C_66  DB_VALUE: 22uF  DB_TOLERANCE: 10%  DB_VOLTAGE: 6.3V  [SMD_1210_CAPC3225X270N]
C_67  DB_VALUE: 22uF  DB_TOLERANCE: 10%  DB_VOLTAGE: 6.3V  [SMD_1210_CAPC3225X270N]
C_68  DB_VALUE: 22uF  DB_TOLERANCE: 10%  DB_VOLTAGE: 6.3V  [SMD_1210_CAPC3225X270N]
C_69  DB_VALUE: 22uF  DB_TOLERANCE: 10%  DB_VOLTAGE: 6.3V  [SMD_1210_CAPC3225X270N]
C_70  DB_VALUE: 22uF  DB_TOLERANCE: 10%  DB_VOLTAGE: 6.3V  [SMD_1210_CAPC3225X270N]
C_71  DB_VALUE: 22uF  DB_TOLERANCE: 10%  DB_VOLTAGE: 6.3V  [SMD_1210_CAPC3225X270N]
C_72  DB_VALUE: 22uF  DB_TOLERANCE: 10%  DB_VOLTAGE: 6.3V  [SMD_1210_CAPC3225X270N]
D1  BAT54C  [SMD_SOT23_SOT95P240X120-3N]
D2  BAT54C  [SMD_SOT23_SOT95P240X120-3N]
D3  BAT54C  [SMD_SOT23_SOT95P240X120-3N]
D4  Red SML210VT ROHM  [SMD_0805_LED2012X100N]
D5  Green 	SML210MT ROHM  [SMD_0805_LED2012X100N]
D6  Yellow SML210YT ROHM  [SMD_0805_LED2012X100N]
D7  Orange 	SML210DT ROHM  [SMD_0805_LED2012X100N]
D8  (OPT)SS14  DB_VALUE: B140  [SMD_DO214AC_SMA]
D9  (OPT)SS14  DB_VALUE: B140  [SMD_DO214AC_SMA]
D10  SS14  DB_VALUE: B140  [SMD_DO214AC_SMA]
D11  SMS05T1G  [SMD_SOT457_SOT95P275X110-6N]
D12  D_TVS_UNI  DB_VALUE: SMCJ12A  [SMD_DO214AC_SMC]
FB1  L_FERRITE_BEAD  DB_VALUE: 220 Ohms  DB_CURRENT: 2A  [SMD_0805_INDC2012X105N]
J1  (OPT) CON PROGRAM  [SIP5 PGM TOP]
J2  CU04SCM15B0-R0  DB_VALUE: USB MINI  [SMD_CON-CVILUX-CU04-SCM15B0]
J3  CON_3PINS  [PTH_CON_3.5mm_3PINs]
J4  WURTH 649 006 295 22  [PTH_CON_PCI-E]
L1  SLC1480-201MLD  [SMD_INDM12501250X800A - Coilcraft SLC1480]
L2  SLC1480-201MLD  [SMD_INDM12501250X800A - Coilcraft SLC1480]
L3  SLC1480-201MLD  [SMD_INDM12501250X800A - Coilcraft SLC1480]
Q1  AP1RA03GMT-3  [SMD_SON127P615X520X100-8N]
Q2  AP1RA03GMT-3  [SMD_SON127P615X520X100-8N]
Q3  AP1RA03GMT-3  [SMD_SON127P615X520X100-8N]
Q4  AP1RA03GMT-3  [SMD_SON127P615X520X100-8N]
Q5  AP1RA03GMT-3  [SMD_SON127P615X520X100-8N]
Q6  AP1RA03GMT-3  [SMD_SON127P615X520X100-8N]
Q7  AP1RA03GMT-3  [SMD_SON127P615X520X100-8N]
Q8  AP1RA03GMT-3  [SMD_SON127P615X520X100-8N]
Q9  AP1RA03GMT-3  [SMD_SON127P615X520X100-8N]
R1  DB_VALUE: 10k  DB_TOLERANCE: 1%  [SMD_0603_RESC1608X55N]
R2  DB_VALUE: 10k  DB_TOLERANCE: 1%  [SMD_0603_RESC1608X55N]
R3  DB_VALUE: 10k  DB_TOLERANCE: 1%  [SMD_0603_RESC1608X55N]
R4  DB_VALUE: 10k  DB_TOLERANCE: 1%  [SMD_0603_RESC1608X55N]
R5  DB_VALUE: 10k  DB_TOLERANCE: 1%  [SMD_0603_RESC1608X55N]
R6  DB_VALUE: 10k  DB_TOLERANCE: 1%  [SMD_0603_RESC1608X55N]
R7  DB_VALUE: 10k  DB_TOLERANCE: 1%  [SMD_0603_RESC1608X55N]
R8  DB_VALUE: 10k  DB_TOLERANCE: 1%  [SMD_0603_RESC1608X55N]
R9  DB_VALUE: 1.02R  DB_TOLERANCE: 1%  [SMD_0603_RESC1608X55N]
R10  DB_VALUE: 1.02R  DB_TOLERANCE: 1%  [SMD_0603_RESC1608X55N]
R11  DB_VALUE: 1.02R  DB_TOLERANCE: 1%  [SMD_0603_RESC1608X55N]
R12  DB_VALUE: 1.02R  DB_TOLERANCE: 1%  [SMD_0603_RESC1608X55N]
R13  DB_VALUE: 1.02R  DB_TOLERANCE: 1%  [SMD_0603_RESC1608X55N]
R14  DB_VALUE: 1.02R  DB_TOLERANCE: 1%  [SMD_0603_RESC1608X55N]
R15  DB_VALUE: 1.02R  DB_TOLERANCE: 1%  [SMD_0603_RESC1608X55N]
R16  DB_VALUE: 1.02R  DB_TOLERANCE: 1%  [SMD_0603_RESC1608X55N]
R17  DB_VALUE: 10k  DB_TOLERANCE: 1%  [SMD_0603_RESC1608X55N]
R18  DB_VALUE: 10k  DB_TOLERANCE: 1%  [SMD_0603_RESC1608X55N]
R19  DB_VALUE: 10k  DB_TOLERANCE: 1%  [SMD_0603_RESC1608X55N]
R20  DB_VALUE: 10k  DB_TOLERANCE: 1%  [SMD_0603_RESC1608X55N]
R21  DB_VALUE: 10k  DB_TOLERANCE: 1%  [SMD_0603_RESC1608X55N]
R22  DB_VALUE: 10k  DB_TOLERANCE: 1%  [SMD_0603_RESC1608X55N]
R23  DB_VALUE: 10k  DB_TOLERANCE: 1%  [SMD_0603_RESC1608X55N]
R24  DB_VALUE: 10k  DB_TOLERANCE: 1%  [SMD_0603_RESC1608X55N]
R25  DB_VALUE: 2.4k  DB_TOLERANCE: 1%  [SMD_0603_RESC1608X55N]
R26  DB_VALUE: 47R  DB_TOLERANCE: 1%  [SMD_0603_RESC1608X55N]
R27  DB_VALUE: 10k  [SMD_0603_RESC1608X55N]
R28  DB_VALUE: 47R  DB_TOLERANCE: 1%  [SMD_0603_RESC1608X55N]
R29  DB_VALUE: 10k  [SMD_0603_RESC1608X55N]
R30  DB_VALUE: 10k  [SMD_0603_RESC1608X55N]
R31  DB_VALUE: 10k  DB_TOLERANCE: 1%  [SMD_0603_RESC1608X55N]
R32  DB_VALUE: 0R  DB_TOLERANCE: 1%  [SMD_0603_RESC1608X55N]
R33  DB_VALUE: 10k  DB_TOLERANCE: 1%  [SMD_0603_RESC1608X55N]
R34  DB_VALUE: 1.02R  DB_TOLERANCE: 1%  [SMD_0603_RESC1608X55N]
R35  DB_VALUE: 1.02R  DB_TOLERANCE: 1%  [SMD_0603_RESC1608X55N]
R36  DB_VALUE: 1.02R  DB_TOLERANCE: 1%  [SMD_0603_RESC1608X55N]
R37  DB_VALUE: 1.02R  DB_TOLERANCE: 1%  [SMD_0603_RESC1608X55N]
R38  DB_VALUE: 1.02R  DB_TOLERANCE: 1%  [SMD_0603_RESC1608X55N]
R39  DB_VALUE: 1.02R  DB_TOLERANCE: 1%  [SMD_0603_RESC1608X55N]
R40  DB_VALUE: 1.02R  DB_TOLERANCE: 1%  [SMD_0603_RESC1608X55N]
R41  DB_VALUE: 1.02R  DB_TOLERANCE: 1%  [SMD_0603_RESC1608X55N]
R42  DB_VALUE: 2R  DB_TOLERANCE: 5%  [SMD_1206_RESC3216X65N]
R43  DB_VALUE: 0R  DB_TOLERANCE: 1%  [SMD_1206_RESC3216X65N]
R44  DB_VALUE: 10k  DB_TOLERANCE: 1%  [SMD_0603_RESC1608X55N]
R45  DB_VALUE: 10k  DB_TOLERANCE: 1%  [SMD_0603_RESC1608X55N]
R46  DB_VALUE: 10k  DB_TOLERANCE: 1%  [SMD_0603_RESC1608X55N]
R47  DB_VALUE: 10k  DB_TOLERANCE: 1%  [SMD_0603_RESC1608X55N]
R48  DB_VALUE: 100R  DB_TOLERANCE: 1%  [SMD_1206_RESC3216X65N]
R49  OPT  DB_VALUE: 0R  DB_TOLERANCE: 1%  [SMD_1206_RESC3216X65N]
R50  DB_VALUE: 10k  DB_TOLERANCE: 1%  [SMD_0603_RESC1608X55N]
R51  DB_VALUE: 30k  DB_TOLERANCE: 1%  [SMD_0603_RESC1608X55N]
R52  DB_VALUE: 10k  DB_TOLERANCE: 1%  [SMD_0603_RESC1608X55N]
R53  DB_VALUE: 30k  DB_TOLERANCE: 1%  [SMD_0603_RESC1608X55N]
R54  DB_VALUE: 10k  DB_TOLERANCE: 1%  [SMD_0603_RESC1608X55N]
R55  DB_VALUE: 10k  DB_TOLERANCE: 1%  [SMD_0603_RESC1608X55N]
R56  DB_VALUE: 1.02R  DB_TOLERANCE: 1%  [SMD_0603_RESC1608X55N]
R57  DB_VALUE: 1.02R  DB_TOLERANCE: 1%  [SMD_0603_RESC1608X55N]
R58  DB_VALUE: 1.02R  DB_TOLERANCE: 1%  [SMD_0603_RESC1608X55N]
R59  DB_VALUE: 1.02R  DB_TOLERANCE: 1%  [SMD_0603_RESC1608X55N]
R60  DB_VALUE: 1.02R  DB_TOLERANCE: 1%  [SMD_0603_RESC1608X55N]
R61  DB_VALUE: 1.02R  DB_TOLERANCE: 1%  [SMD_0603_RESC1608X55N]
R62  DB_VALUE: 1.02R  DB_TOLERANCE: 1%  [SMD_0603_RESC1608X55N]
R63  DB_VALUE: 1.02R  DB_TOLERANCE: 1%  [SMD_0603_RESC1608X55N]
R64  DB_VALUE: 10k  DB_TOLERANCE: 1%  [SMD_0603_RESC1608X55N]
R65  DB_VALUE: 10k  DB_TOLERANCE: 1%  [SMD_0603_RESC1608X55N]
R66  DB_VALUE: 10k  DB_TOLERANCE: 1%  [SMD_0603_RESC1608X55N]
R67  DB_VALUE: 10k  DB_TOLERANCE: 1%  [SMD_0603_RESC1608X55N]
R68  DB_VALUE: 1.02R  DB_TOLERANCE: 1%  [SMD_0603_RESC1608X55N]
R69  DB_VALUE: 1.02R  DB_TOLERANCE: 1%  [SMD_0603_RESC1608X55N]
R70  DB_VALUE: 1.02R  DB_TOLERANCE: 1%  [SMD_0603_RESC1608X55N]
R71  DB_VALUE: 1.02R  DB_TOLERANCE: 1%  [SMD_0603_RESC1608X55N]
R72  DB_VALUE: 1.02R  DB_TOLERANCE: 1%  [SMD_0603_RESC1608X55N]
R73  DB_VALUE: 1.02R  DB_TOLERANCE: 1%  [SMD_0603_RESC1608X55N]
R74  DB_VALUE: 1.02R  DB_TOLERANCE: 1%  [SMD_0603_RESC1608X55N]
R75  DB_VALUE: 1.02R  DB_TOLERANCE: 1%  [SMD_0603_RESC1608X55N]
TP1  TEST_POINT_1  [SMD_TP_100-254]  (value not drawn)
TP2  TEST_POINT_1  [SMD_TP_100-254]  (value not drawn)
TP3  TEST_POINT_1  [SMD_TP_100-254]  (value not drawn)
TP4  TEST_POINT_1  [SMD_TP_100-254]  (value not drawn)
TP5  TEST_POINT_1  [SMD_TP_100-254]  (value not drawn)
TP6  TEST_POINT_1  [SMD_TP_100-254]  (value not drawn)
TP7  TEST_POINT_1  [SMD_TP_100-254]  (value not drawn)
TP8  TEST_POINT_1  [SMD_TP_100-254]  (value not drawn)
TP9  TEST_POINT_1  [SMD_TP_100-254]  (value not drawn)
TP10  TEST_POINT_1  [SMD_TP_100-254]  (value not drawn)
TP11  TEST_POINT_1  [SMD_TP_100-254]  (value not drawn)
TP12  TEST_POINT_1  [SMD_TP_100-254]  (value not drawn)
TP13  TEST_POINT_1  [SMD_TP_100-254]  (value not drawn)
TP14  TEST_POINT_1  [SMD_TP_100-254]  (value not drawn)
TP15  TEST_POINT_1  [SMD_TP_100-254]  (value not drawn)
TP16  TEST_POINT_1  [SMD_TP_100-254]  (value not drawn)
TP17  TEST_POINT_1  [SMD_TP_100-254]  (value not drawn)
TP18  TEST_POINT_1  [SMD_TP_100-254]  (value not drawn)
TP19  TEST_POINT_1  [SMD_TP_100-254]  (value not drawn)
U1  GC3355Q64  [SMD_QFN50P800X800X80-65N - GRIDSEED]  (no BOM)
U2  GC3355Q64  [SMD_QFN50P800X800X80-65N - GRIDSEED]  (no BOM)
U3  GC3355Q64  [SMD_QFN50P800X800X80-65N - GRIDSEED]  (no BOM)
U4  GC3355Q64  [SMD_QFN50P800X800X80-65N - GRIDSEED]  (no BOM)
U5  GC3355Q64  [SMD_QFN50P800X800X80-65N - GRIDSEED]  (no BOM)
U6  GC3355Q64  [SMD_QFN50P800X800X80-65N - GRIDSEED]  (no BOM)
U7  GC3355Q64  [SMD_QFN50P800X800X80-65N - GRIDSEED]  (no BOM)
U8  GC3355Q64  [SMD_QFN50P800X800X80-65N - GRIDSEED]  (no BOM)
U9  GC3355Q64  [SMD_QFN50P800X800X80-65N - GRIDSEED]  (no BOM)
U10  GC3355Q64  [SMD_QFN50P800X800X80-65N - GRIDSEED]  (no BOM)
U11  GC3355Q64  [SMD_QFN50P800X800X80-65N - GRIDSEED]  (no BOM)
U12  GC3355Q64  [SMD_QFN50P800X800X80-65N - GRIDSEED]  (no BOM)
U13  GC3355Q64  [SMD_QFN50P800X800X80-65N - GRIDSEED]  (no BOM)
U14  GC3355Q64  [SMD_QFN50P800X800X80-65N - GRIDSEED]  (no BOM)
U15  GC3355Q64  [SMD_QFN50P800X800X80-65N - GRIDSEED]  (no BOM)
U16  GC3355Q64  [SMD_QFN50P800X800X80-65N - GRIDSEED]  (no BOM)
U17  LTC 4449  [SMD_DFN16166SON50P161X161X60-9N - LTC4449]
U18  LTC 4449  [SMD_DFN16166SON50P161X161X60-9N - LTC4449]
U19  LTC 4449  [SMD_DFN16166SON50P161X161X60-9N - LTC4449]
U20  IC_DSPIC33EP256MU806-QFN64  DB_VALUE: dsPIC33EP256MU806  [SMD_QFP50P1200X1200X120-64N]
U21  (OPT) LM7805  [SMD_SOIC127P602X173-8N]
U22  (OPT)BU33TD3WG-TR  [SMD_SOT26_SOT95P285X140-5N - DLV]
U23  BD33KA5WF  [SMD_SOIC127P602X173-8N]
U24  (OPT) L7805CD2T-TR  [SMD_TO254P1524X483-3_4N_D2PAK]
U25  L78M05CDT-TR  [SMD_TO229P991X239-4AN_DPAK]
U26  BD18KA5WF-old  [SMD_SOIC127P602X173-8N]
U27  BD18KA5WF-old  [SMD_SOIC127P602X173-8N]
Y1  4.00MHz HC49/4HSMX  [SMD_HC49_XTAL1140X480X420N]